# EasyEDA Pro project rckid3_devboard.eprj, board RCKid (continued)
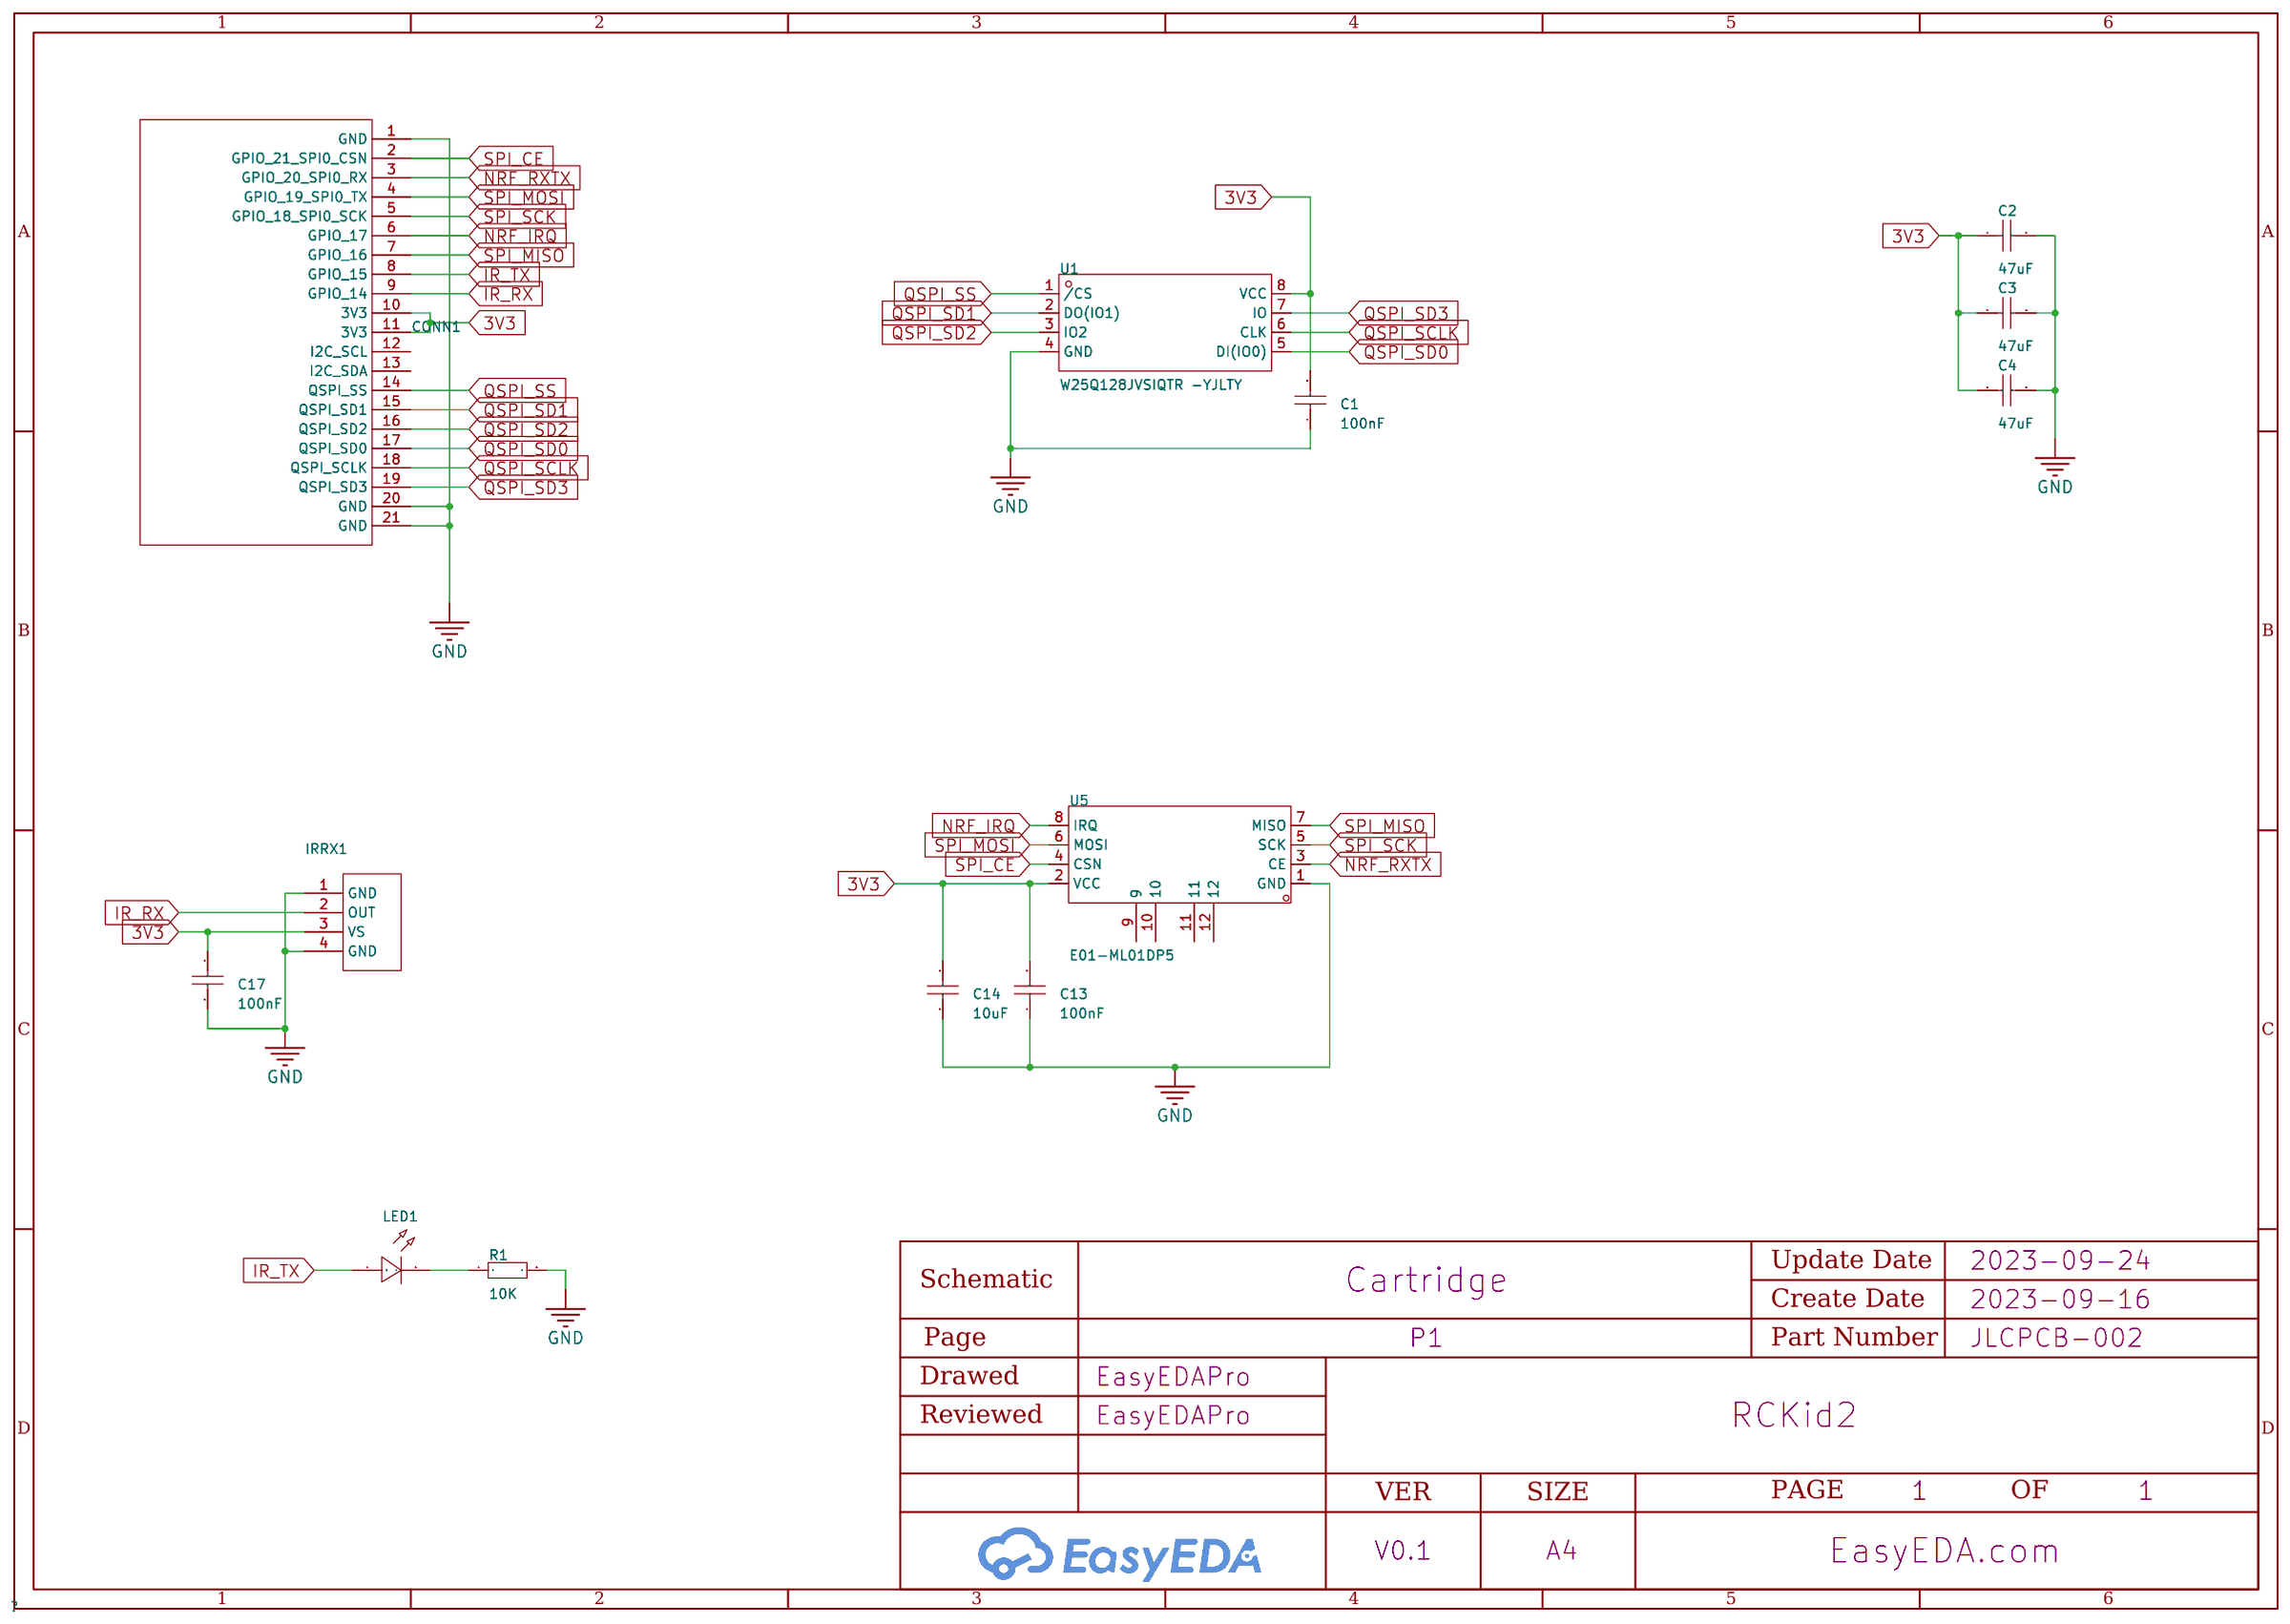
[diagram p0: NRF24L01P]
## Footprints (pads in the part's own frame, mm; a bottom-side part is the same pattern mirrored in y, then rotated) (continued)
SMT wire pad (2)
  rect 2.54x1.524 smd: 1(0,0)
  rrect 2.54x1.524 smd: 2(0,-2.54)
SOD-323_L1.8-W1.3-LS2.5-RD
  rect 1x0.75 smd: 1(-1.173,0) 2(1.173,0)
SOT-23-3_L2.9-W1.6-P1.90-LS2.8-BR
  rect 1.07x0.6 smd: 1(1.235,-0.95) 2(1.235,0.95) 3(-1.235,0)
SOT-23-6_L2.9-W1.6-P0.95-LS2.8-BR
  rect 1.1x0.6 smd: 1(1.35,-0.95) 2(1.35,0) 3(1.35,0.95) 4(-1.35,0.95) 5(-1.35,0) 6(-1.35,-0.95)
SOT-23_L2.9-W1.3-P1.90-LS2.4-BR
  rect 1x0.8 smd: 1(1.15,-0.95) 2(1.15,0.95) 3(-1.15,0)
TESTPOINT-SMD_BD1.5_P70-5000045R
  round 2 smd: 1(0,0)
TF-SMD_TF-01A
  rect 0.6x1.3 smd: 1(2.3,5.276) 2(1.2,5.276) 3(0.101,5.276) 4(-1,5.276) 5(-2.099,5.276) 6(-3.2,5.276) 7(-4.3,5.276) 8(-5.399,5.276) 9(-6.5,5.276)
  rect 1.2x1.4 smd: 10(-7.599,4.426) 13(7.08,4.426)
  rect 1.2x2 smd: 11(-7.76,-5.276) 12(7.76,-5.276)
UDFN-16_L3.3-W1.4-P0.40-BL-EP
  rect 0.2x0.4 smd: 1(-1.4,-0.6) 2(-1,-0.6) 3(-0.6,-0.6) 4(-0.2,-0.6) 5(0.2,-0.6) 6(0.6,-0.6) 7(1,-0.6) 8(1.4,-0.6) 9(1.4,0.6) 10(1,0.6) 11(0.6,0.6) 12(0.2,0.6) 13(-0.2,0.6) 14(-0.6,0.6) 15(-1,0.6) 16(-1.4,0.6)
  rect 2.8x0.4 smd: 17(0,0)
UQFN-10_L2.0-W1.5-P0.50-BL-EP
  rect 0.3x0.58 smd: 1(-0.748,-0.64) 4(0.752,-0.64) 6(0.752,0.64) 9(-0.748,0.64)
  rect 0.25x0.58 smd: 2(-0.248,-0.64) 3(0.252,-0.64) 7(0.252,0.64) 8(-0.248,0.64)
  rect 0.63x0.35 smd: 5(0.86,0) 10(-0.86,-0.002)
USB-C-SMD_TYPE-C-F02C-1BBWC1.6
  oval 1.2x2 hole 0.65x1.4: 13(5.62,1.425) 16(-5.62,1.425)
  oval 1.2x2.4 hole 0.65x1.8: 14(5.62,-2.575) 15(-5.62,-2.575)
  rect 0.3x1.1 smd: A5(-1.25,2.575) A6(-0.25,2.575) A7(0.25,2.575) A8(1.25,2.575) B5(1.75,2.575) B6(0.75,2.575) B7(-0.75,2.575) B8(-1.75,2.575)
  rect 0.6x1.1 smd: A9B4(2.4,2.575) A12B1(3.2,2.575) B9A4(-2.4,2.575) B12A1(-3.2,2.575)
VSON-6_L1.5-W1.5-P0.50-TL
  rect 0.6x0.25 smd: 1(-0.575,0.5) 2(-0.575,0) 3(-0.575,-0.5)
  rect 1x0.25 smd: 4(0.575,-0.5) 5(0.575,0) 6(0.575,0.5)
VSON-8_L3.0-W3.0-P0.65-TL-EP
  rect 0.85x0.34 smd: 1(-1.476,0.975) 2(-1.476,0.325) 3(-1.476,-0.325) 4(-1.476,-0.976) 5(1.476,-0.976) 6(1.476,-0.325) 7(1.476,0.325) 8(1.476,0.976)
  custom 1.52x3.42 smd: 9(0,-0.005)
WQFN-24_L4.0-W4.0-P0.50-TL-EP2.6
  rect 0.85x0.25 smd: 1(-2.025,1.25) 2(-2.025,0.75) 3(-2.025,0.25) 4(-2.025,-0.25) 5(-2.025,-0.75) 6(-2.025,-1.25) 13(2.025,-1.25) 14(2.025,-0.75) 15(2.025,-0.25) 16(2.025,0.25) 17(2.025,0.75) 18(2.025,1.25)
  rect 0.25x0.85 smd: 7(-1.25,-2.025) 8(-0.75,-2.025) 9(-0.25,-2.025) 10(0.25,-2.025) 11(0.75,-2.025) 12(1.25,-2.025) 19(1.25,2.025) 20(0.75,2.025) 21(0.25,2.025) 22(-0.25,2.025) 23(-0.75,2.025) 24(-1.25,2.025)
  rect 2.6x2.6 smd: 25(0.001,0)

## Nets
As in the schematic.

Pads without a net: 3V3 2; AMP 2; AUDIO 33; DISPLAY 1 2 3 4 8 25 26 27 28 34 35 36 37 38 39 40 41 42; HEADSET 5 6; L15 7 8 9 10; microSD 9 12 13; PWR 4 24; R88 2; RADIO 1 15 16 20 21; RP2350B 35 59; U26 4 10 11; U41 2 5; USB 13 14 15 16 A8 B8; VDD 2

## Via types
v1: diameter 0.5, hole 0.3, Top Layer to Bottom Layer, 660 vias

## Routing (per net, layer and track width the routed paths; a pad name or vN(x,y) marks a point on that pad's centre or on a via; arc(x,y) is an arc through that point)
3V3: length 31.2
  Top Layer w0.15: U26.5 44.9,38.69 43.9,39.69 U26.12 ; v1(47.7,41.79) 48.37,41.79 R124.2 ; 44.9,28.39 44.9,29.59 45.2,29.59 v1(45.8,30.19)
  Top Layer w0.25: U26.5 46.85,38.69 C95.2 ; U40.8 38.79,52.94 ; U41.1 45.85,53.84 45.2,53.19 44.74,53.19 C235.2 ; U26.8 45.05,40.94 45.55,41.44 45.55,41.99 ; AVR.4 49.25,44.8 C118.2
  Top Layer w0.3: U33.5 56.3,45.39 55.35,46.34 U33.1
  Top Layer w0.5: R45.2 v1(42.4,45.39) ; C234.2 38.8,52.94 v1(38.8,52.19) ; v1(52.8,46.19) 53.6,46.19 53.75,46.34 U33.1 ; C95.2 v1(46.9,37.79) ; C235.2 v1(44.5,52.09) ; 45.55,41.99 45.5,42.05 v1(45.5,42.69) ; v1(49.5,43.69) 49.5,44.44 C118.2 ; R46.2 v1(42.4,44.09)
  Bottom Layer w0.15: v1(45.8,30.19) 45.8,35.19 v1(45.4,35.59)
  vias: v1(45.4,36.39) v1(46.2,36.39) v1(46.2,35.59)
5V: length 20.1
  Top Layer w0.25: v1(62.05,45.14) 62,45.19 58.8,45.19 57.65,46.34 U33.6
  Top Layer w0.3: v1(40.4,25.29) 39.45,26.24 39.3,26.24 C143.2 39.11,26.24 LED11.2 ; v1(57,23.49) 57,22.64 C144.2 57.05,22.5 LED12.2 ; LED8.2 72.1,51.94 C102.2 71.86,51.99 v1(71.1,51.99) ; LED10.2 30.45,43.39 C104.2 v1(31.3,43.59)
  Top Layer w0.5: 52.3,22.59 v1(52.7,22.19) v1(51.9,22.19) 52.3,22.59 ; 52.3,22.59 C82.2 52.15,23.04 5V.1
  vias: v1(60.4,29.89)
5V_ON: length 30.8
  Top Layer w0.15: v1(44.9,46.29) 44.9,45.82 R48.1 ; 5V.3 50.5,24.89 v1(49.2,24.89) ; AVR.21 46.15,48.44 45.9,48.69 45.3,48.69 44.9,48.29 v1(44.9,48.09)
  Bottom Layer w0.15: v1(49.2,24.89) 44.2,29.89 44.2,45.19 44.9,45.89 v1(44.9,46.29) v1(44.9,48.09)
DVDD: length 10.3
  Top Layer w0.2: C114.2 22.6,78.09 v1(23,78.49) 23.3,78.79 RP2350B.51 ; RP2350B.32 29.6,86.09 v1(29.4,86.29) 28.8,86.89 28.8,87.05 ; C115.2 v1(37.5,78.69) 37.3,78.69 37.2,78.79 RP2350B.10
GND: length 81.5
  Top Layer w0.15: R113.2 17.93,19.42 v1(17.9,19.39) ; 30.5,19.29 v1(30.5,20.09) 30.5,20.79 ; U40.3 42.45,53.44 v1(42.6,53.59) ; v1(51.1,42.79) 50.53,42.79 50.5,42.82
  Top Layer w0.2: 19.6,6.26 19.8,6.06 v1(19.8,5.39) ; v1(21,5.39) R57.2 ; v1(28,88.19) 28.55,88.19 28.6,88.14
  Top Layer w0.25: v1(73.7,18.59) 74.02,18.91 74.02,19.5 ; v1(20,79.09) C110.1 ; v1(32,88.29) 31.26,88.29 31.2,88.24 ; v1(28.1,90.39) 28.1,89.95 C154.2 ; U39.2 29.35,92.89 v1(28.2,92.89) ; v1(40.4,78.69) C115.1 ; 75.35,34.74 74.35,35.74 AUDIO.7 ; 75.35,34.74 75.85,34.24 AUDIO.28 ; 75.35,34.74 AUDIO.12 ; AVR.25 48.75,47.94 AVR.3 ; U39.4 31.65,91.09 v1(33,91.09) ; v1(72.8,17.59) 73.02,17.37 RADIO.3 ; v1(22.1,72.69) 22.1,73.55 ; C107.1 39.74,73.95 39.74,73.9 39.85,73.79 v1(39.9,73.79) ; v1(72.3,39.29) 72.3,38.55 C209.1 ; v1(35.6,87.29) 35.6,86.55 C109.1 ; v1(58.1,23.49) 58.1,22.65 C144.1 ; LED12.3 58.1,19.59 v1(58.1,18.79) ; 81.3,24.59 80.9,24.99 80.5,24.99 ; LED8.3 74.9,52.89 v1(74.9,53.79) ; v1(33.3,89.49) C153.2 ; C167.1 29.45,69.79 v1(30.2,69.79) ; 81.4,24.59 v1(83,22.99) ; v1(40.4,81.19) C112.1 ; 46.3,52.49 v1(46.3,51.89) ; v1(20,78.09) C114.1 ; v1(23.1,85.19) C111.1 ; AUDIO.17 73.85,32.64 v1(74.5,33.29) ; v1(35.6,69.69) C108.1
  Top Layer w0.3: v1(70.7,74.59) R55.2 ; C143.1 v1(39.2,24.39) ; 72,52.94 v1(72,53.79) ; LED10.3 28.9,40.99 v1(28.9,40.09) ; LED11.3 36.5,25.29 v1(36.5,24.39) ; C104.1 v1(28.1,43.59)
  Top Layer w0.4: v1(81.4,35.39) 81.1,35.09 C192.1 ; v1(82.7,35.39) 82.1,34.79 C204.2 ; v1(31.9,10.59) USB.A12B1 32.67,9.56 v1(32.7,9.59) ; v1(25.5,10.59) USB.B12A1 25.48,9.59 v1(24.7,9.59) ; v1(74.9,28.09) 74.9,29.05 ; v1(81.1,36.59) 80.14,36.59 C203.2 ; v1(70.9,25.29) R104.1
  Top Layer w0.5: 44.5,54.09 44.5,54.39 v1(45,54.89) ; v1(18.5,21.29) 18.5,20.59 ; v1(24.6,27.79) 24.6,26.99 ; 24.6,26.99 v1(23.9,26.99) ; 24.6,26.99 24.6,26.79 ; 37.5,52.99 36.8,52.99 v1(36.79,53) ; v1(50.6,43.69) 50.6,44.45 C118.1 ; v1(68.7,74.79) 67.58,74.79 Q6.2 67.5,74.78 v1(67.5,75.59) ; 73.5,22.49 v1(73.5,21.79) 73.5,21.09 ; v1(42.4,50.59) 41.6,50.59 ; v1(50.6,34.79) 50.6,35.49 ; v1(50.9,37.39) 50.9,38.39 ; C132.1 66,89.09 v1(65,89.09) ; 55.8,51.09 56.4,51.09 v1(56.9,51.59) ; 37.7,53.99 37,53.99 v1(36.99,54) ; 26.5,26.99 26.4,26.99 ; 26.5,26.99 26.5,26.89 ; 26.5,26.99 v1(26.5,27.79) ; 26.5,26.99 v1(27.3,26.99) ; C81.1 v1(45.2,24.69) ; v1(56.89,52.7) 56.88,52.69 55.9,52.69 ; v1(51.1,36.39) 51.8,36.39 ; v1(46.9,40.79) 46.9,39.89 ; 21.2,20.39 21.1,20.39 v1(20.5,19.79) ; v1(46.6,42.69) 46.6,42.09 ; v1(21.4,17.89) 21.4,18.79 ; v1(46.3,44.39) 45.5,44.39 ; v1(53.3,45.39) 54.3,45.39 ; v1(63,8.49) 61.8,8.49 ; v1(24.1,16.99) 24.1,17.69
  vias: v1(-15.5,49.69) v1(-15.5,48.59) v1(-15.4,44.99) v1(-15.3,43.29) v1(-15.1,46.79) v1(-14.55,54.38) v1(-14.4,62.49) v1(-13.8,42.39) v1(-13.6,45.59) v1(-13.5,77.89) v1(-13.5,75.89) v1(-13.5,73.89) v1(-13.2,48.29) v1(-13.1,50.19) v1(-13,43.79) v1(-12.9,60.99) v1(-12.7,45.99) v1(-12.6,39.99) v1(-12,74.59) v1(-12,61.89) v1(-11.7,48.49) v1(-11.2,44.69) v1(-11,62.59) v1(-10.8,49.89) v1(-10.5,46.59) v1(-10.3,58.79) v1(-10.3,43.49) v1(-10.2,48.29) v1(-10,73.49) v1(-10,31.99) v1(-9.2,44.49) v1(-8.6,42.79) v1(-8.4,58.99) v1(-8.4,56.19) v1(-8.4,47.99) v1(-8.4,36.19) v1(-8.4,33.79) v1(-8.2,74.59) v1(-8.2,54.09) v1(-8,45.79) v1(-7.8,49.69) v1(-7.7,32.59) v1(-7.6,40.19) v1(-7.2,47.59) v1(-6.2,42.89) v1(-6.2,39.29) v1(-6.1,37.49) v1(-5.9,77.49) v1(-5.9,71.99) v1(-5.9,69.99) v1(-5.9,67.99) v1(-5.9,65.99) v1(-5.9,64.19) v1(-5.8,47.29) v1(-5.7,74.59) v1(-5.6,44.99) v1(-5.6,41.59) v1(-5.1,34.69) v1(-4.5,44.29) v1(-4.3,83.89) v1(-4.3,47.89) v1(-3.9,65.99) v1(-3.9,64.19) v1(-3.9,36.99) v1(-3.7,45.69) v1(-3.5,71.99) v1(-3.1,74.59) v1(-3,77.59) v1(-2.2,38.89) v1(-1.9,78.39) v1(-1.8,76.59) v1(-1.7,51.59) v1(-1.5,41.79) v1(-1.2,38.89) v1(-1.1,46.19) v1(-1,47.89) v1(-0.9,64.19) v1(-0.7,77.29) v1(-0.6,74.59) v1(-0.2,58.19) v1(0,61.09) v1(0,46.19) v1(0.2,43.59) v1(0.4,52.09) v1(0.7,77.29) v1(0.7,53.69) v1(0.7,49.59) v1(1.2,47.79) v1(1.7,74.59) v1(1.7,40.69) v1(1.9,51.39) v1(1.9,46.49) v1(2,61.09) v1(2.1,44.09) v1(2.2,77.59) v1(2.6,57.49) v1(2.7,73.59) v1(2.7,52.49) v1(2.9,40.09) v1(3.2,55.69) v1(3.2,43.19) v1(3.3,76.99) v1(3.3,45.59) v1(3.7,64.19) v1(3.7,49.99) v1(3.9,74.99) v1(4.1,59.99) v1(4.2,57.09) v1(4.2,41.89) v1(4.4,76.19) v1(4.4,43.89) v1(4.5,47.09) v1(4.6,53.49) v1(4.6,49.19) v1(4.9,40.59) v1(5.2,42.69) v1(5.4,81.79) v1(5.5,40.19) v1(5.6,43.79) v1(5.7,52.59) v1(6,50.59) v1(6.1,94.89) v1(6.2,47.59) v1(6.4,88.19) v1(6.4,83.79) v1(6.6,45.29) v1(6.7,46.49) v1(6.9,38.69) v1(7.1,41.59) v1(7.2,48.99) v1(7.3,88.09) v1(7.4,44.39) v1(7.5,51.49) v1(7.9,96.79) v1(7.9,47.29) v1(8.5,86.39) v1(9,90.79) v1(9,40.49) v1(9.6,51.19) v1(9.8,45.79) v1(10.7,46.29) v1(11.2,93.39) v1(16.9,107.89) v1(17,103.19) v1(18.2,103.99) v1(19,103.69) v1(20.2,109.89) v1(20.2,103.99) v1(21.3,103.89) v1(22.2,103.99) v1(22.9,69.79) v1(23.5,107.09) v1(24.2,103.99) v1(25.8,22.39) v1(25.8,20.79) v1(25.8,13.59) v1(26.2,103.99) v1(26.4,109.99) v1(27.5,20.79) v1(27.6,22.39) v1(28.2,103.99) v1(28.8,80.39) v1(28.8,78.99) v1(28.8,77.59) v1(29.4,109.99) v1(30.1,53.49) v1(30.2,103.99) v1(30.2,80.39) v1(30.2,78.99) v1(30.2,77.59) v1(30.5,15.39) v1(31.5,24.89) v1(31.6,80.39) v1(31.6,78.99) v1(31.6,77.59) v1(32.2,103.99) v1(32.2,49.99) v1(34.1,109.99) v1(34.2,103.99) v1(36.2,103.99) v1(36.4,107.89) v1(36.4,105.49) v1(38.1,109.99) v1(42.2,109.99) v1(42.2,103.59) v1(43.2,6.49) v1(43.7,2.49) v1(44.6,-2.01) v1(44.8,-0.01) v1(45.2,31.89) v1(45.8,6.99) v1(46.1,-4.31) v1(46.3,31.89) v1(47,4.79) v1(47.2,1.09) v1(47.3,8.29) v1(47.5,109.99) v1(47.9,8.19) v1(48.2,48.99) v1(48.2,47.39) v1(48.8,8.49) v1(49.5,1.49) v1(49.6,23.99) v1(49.7,9.19) v1(49.8,48.99) v1(49.8,47.39) v1(50.4,103.39) v1(50.5,8.89) v1(50.5,1.79) v1(50.6,6.29) v1(50.8,10.19) v1(50.9,109.99) v1(51.2,-0.61) v1(51.7,10.69) v1(51.8,6.69) v1(51.9,10.79) v1(51.9,8.09) v1(52,7.89) v1(52.1,9.49) v1(52.1,4.69) v1(52.2,25.69) v1(52.8,9.49) v1(53.1,10.89) v1(53.4,5.89) v1(53.5,9.29) v1(54.4,109.99) v1(54.4,11.49) v1(54.9,103.59) v1(55,7.99) v1(55.1,92.19) v1(55.7,10.29) v1(55.9,12.79) v1(56,11.79) v1(56.7,39.99) v1(56.7,39.19) v1(56.9,13.49) v1(57,103.19) v1(57,9.89) v1(57.2,11.59) v1(57.4,109.99) v1(57.6,8.79) v1(57.9,12.79) v1(58.1,13.79) v1(58.1,6.59) v1(58.4,103.59) v1(58.5,10.69) v1(58.5,9.89) v1(58.6,11.79) v1(59,42.59) v1(59.5,6.29) v1(59.7,103.49) v1(60.4,109.99) v1(60.4,30.89) v1(61.2,103.09) v1(61.7,103.69) v1(62.6,103.19) v1(63.3,109.99) v1(63.5,103.19) v1(64.7,103.39) v1(64.8,30.79) v1(65.2,109.99) v1(66.2,103.99) v1(66.2,99.99) v1(66.2,95.99) v1(67.2,109.99) v1(67.4,106.49) v1(70.2,103.99) v1(70.2,95.99) v1(70.2,91.99) v1(70.2,87.99) v1(71,23.09) v1(71.3,107.29) v1(71.8,103.69) v1(72,25.69) v1(72.8,18.59) v1(73.2,109.99) v1(73.7,17.59) v1(74.2,103.99) v1(74.2,99.99) v1(74.2,95.99) v1(74.2,91.99) v1(74.2,87.99) v1(74.5,35.69) v1(74.9,25.69) v1(75.4,15.89) v1(75.8,25.39) v1(76.5,103.89) v1(76.8,105.19) v1(76.8,35.79) v1(76.85,33.24) v1(77.5,109.99) v1(78.2,103.99) v1(78.2,95.99) v1(78.2,91.99) v1(78.2,87.99) v1(79.2,5.09) v1(79.6,106.19) v1(79.6,103.99) v1(80.6,109.79) v1(81.1,65.09) v1(82.2,103.99) v1(82.2,99.99) v1(82.2,97.99) v1(82.2,95.99) v1(82.2,93.99) v1(82.2,91.99) v1(82.2,89.99) v1(82.2,87.99) v1(82.2,85.99) v1(82.2,83.99) v1(82.2,81.99) v1(82.2,79.99) v1(82.2,77.99) v1(82.2,75.69) v1(82.2,72.99) v1(82.2,70.09) v1(82.7,65.09) v1(82.7,31.29) v1(83.5,107.89) v1(83.5,105.29) v1(83.6,67.79) v1(83.6,26.39) v1(85.8,42.49) v1(92.3,73.69) v1(93.1,75.09) v1(94.7,73.69) v1(95.2,92.59) v1(95.2,88.89) v1(95.2,84.79) v1(96.2,82.29) v1(96.7,83.99) v1(97.2,90.49) v1(97.3,73.69) v1(97.5,85.39) v1(97.6,72.29) v1(98.2,86.79) v1(98.5,78.29) v1(98.6,93.19) v1(98.62,72.24) v1(98.7,82.49) v1(98.7,75.79) v1(98.9,72.89) v1(99,89.39) v1(99.2,80.39) v1(99.6,76.29) v1(99.6,71.39) v1(99.8,84.59) v1(99.9,73.69) v1(100,90.49) v1(100.9,88.09) v1(101.5,86.19) v1(101.5,80.49) v1(101.7,91.39) v1(101.7,75.09) v1(101.9,79.89) v1(101.9,77.19) v1(102.1,93.69) v1(102.4,82.89) v1(102.4,74.29) v1(102.6,89.69) v1(102.8,84.49) v1(103.5,78.19) v1(103.6,79.79) v1(103.7,73.69) v1(103.8,87.19) v1(104.1,75.39) v1(104.2,85.29) v1(104.7,93.79) v1(104.8,80.99) v1(104.8,72.09) v1(104.9,89.99) v1(105.3,83.59) v1(105.4,77.19) v1(106.2,80.29) v1(106.3,73.69) v1(106.6,85.69) v1(106.8,88.29) v1(107.3,91.69) v1(107.3,77.89) v1(107.5,74.59) v1(107.6,82.79) v1(109.2,72.89) v1(111,73.69)
VBATT: length 4
  Bottom Layer w0.15: v1(33,16.49) R126.2
  Bottom Layer w0.5: v1(33,16.49) v1(33,14.49)
VCC: length 10.7
  Top Layer w0.15: 42.7,32.49 42.7,31.39
  Top Layer w0.5: v1(48.8,23.99) 5V.5 46.8,23.99 C81.2
  Top Layer w0.7: C220.2 C219.2 22.45,25.39 L17.2 22.1,27.96 AAA_PWR.2
  vias: v1(27.5,25.59) v1(27.5,24.79) v1(28.3,25.59) v1(28.3,24.79) v1(29.1,25.59) v1(29.1,24.79) v1(39.4,32.99) v1(39.4,32.29) v1(40.1,32.99) v1(40.1,32.29) v1(49.4,39.89) v1(49.4,39.19) v1(50.1,39.89) v1(50.1,39.19)
VDD_EN: length 28.1
  Top Layer w0.15: v1(42,54.99) 41.7,54.99 41.2,54.49 U40.5 ; 52.7,38.19 52.2,38.19 52,38.39 v1(52,38.59) ; v1(46.6,50.49) 43.6,50.49 v1(42.4,51.69) 41.84,52.25 U40.1 ; AVR.5 49.75,45.44 49.9,45.29 v1(50.8,45.29)
  Bottom Layer w0.15: v1(46.6,50.49) 47.5,50.49 50.8,47.19 v1(50.8,45.29) 50.8,44.29 52,43.09 v1(52,38.59) ; v1(42,54.99) 42,52.09 v1(42.4,51.69)
ACCEL_INT: length 9.4
  Top Layer w0.15: v1(44.8,41.69) 44.55,41.44 U26.9 ; v1(45.6,48.09) 45.9,48.09 46.05,47.94 AVR.22
  Bottom Layer w0.15: v1(44.8,41.69) 44.8,44.79 45.6,45.59 v1(45.6,48.09)
AUDIO_INT: length 67.5
  Top Layer w0.15: AUDIO.11 69.95,35.24 68.9,36.29 68.9,39.99 66.9,41.99 66.9,53.49 63.7,56.69 50.7,56.69 50.3,57.09 47.5,57.09 46,58.59 46,62.39 39.1,69.29 39.1,71.69 36,74.79 36,75.09 35.5,75.59 RP2350B.2
AUDIO_MICBIAS: length 7
  Top Layer w0.15: AUDIO.19 74.85,31.44 v1(75.1,31.19) ; R123.2 v1(70.9,30.89) R103.2
  Bottom Layer w0.15: v1(70.9,30.89) 74.8,30.89 v1(75.1,31.19)
AUDIO_RESET: length 74.8
  Top Layer w0.15: RP2350B.8 36.8,77.99 37.4,77.39 39.5,77.39 42.1,74.79 42.1,70.74 49.15,63.69 49.8,63.69 51.61,61.89 51.61,60.29 52.2,59.69 65.3,59.69 69.9,55.09 69.9,43.49 70.5,42.89 76.5,42.89 78.8,40.59 78.8,35.99 78.55,35.74 AUDIO.31
AVR_INT: length 33.7
  Top Layer w0.15: RP2350B.80 34.91,74.08 v1(37.8,71.19) ; v1(42.4,49.19) 44.1,49.19 44.2,49.29 46,49.29 46.35,48.94 AVR.20
  Bottom Layer w0.15: v1(42.4,49.19) 39.6,51.99 39.6,56.24 38.7,57.14 38.7,70.29 v1(37.8,71.19)
AVR_TX: length 36.5
  Top Layer w0.15: v1(28.8,57.09) 30.3,57.09 40.45,46.94 AVR.24
  Bottom Layer w0.15: DEBUG.1 24.02,57.09 v1(28.8,57.09)
BTN_1: length 45
  Top Layer w0.15: D17.2 D9.2 59.23,51.19 57.8,51.19 v1(56.5,49.89) 56.05,49.44 51.02,49.44
  Top Layer w0.2: D5.2 51,18.69 v1(51.9,19.59)
  Bottom Layer w0.15: v1(51.9,19.59) 53.9,21.59 53.9,47.29 56.6,49.99
BTN_2: length 46.4
  Top Layer w0.15: 51.02,47.94 59.28,47.94 D14.2 D10.2
  Top Layer w0.2: D6.2 49.3,18.79 49.5,18.99 v1(50.2,18.99)
  Bottom Layer w0.15: v1(58.3,47.99) 57.6,47.99 55.1,45.49 55.1,20.49 53.6,18.99 v1(50.2,18.99)
BTN_3: length 48.2
  Top Layer w0.15: D11.2 52.7,17.89 51.8,16.99 48.5,16.99 47.6,17.89 D7.2 ; D15.2 58.3,49.59 v1(57.9,49.19) 57.15,48.44 51.02,48.44
  Top Layer w0.2: v1(54,20.49) 54,19.52 52.7,18.22
  Bottom Layer w0.15: v1(54,20.49) 54.5,20.99 54.5,45.79 v1(57.9,49.19)
BTN_4: length 38.8
  Top Layer w0.15: v1(52.9,44.09) 50.83,46.17 AVR.6
  Top Layer w0.2: D12.2 44.2,18.89 44.5,19.19 v1(45,19.19) 45.6,19.19 45.9,18.89 D8.2
  Bottom Layer w0.15: v1(45,19.19) 45.7,19.89 51.3,19.89 53.3,21.89 53.3,43.69 v1(52.9,44.09)
BTN_ABXY: length 102.7
  Top Layer w0.15: 51.02,47.44 57.95,47.44 v1(58.3,47.09) ; B1.4 B1.2 v1(71.2,45.59) ; 60.1,18.09 B2.2 55.7,17.99 v1(55,18.69) 52.7,16.39 41.75,16.39 40.2,17.94 B3.4 ; A1.4 A1.2 v1(56.5,33.49)
  Top Layer w0.2: B3.4 B3.2 ; B2.4 B2.2
  Bottom Layer w0.15: v1(55,18.69) 55.7,19.39 55.7,32.69 v1(56.5,33.49) 55.7,34.29 55.7,45.19 57.6,47.09 v1(58.3,47.09) 69.7,47.09 v1(71.2,45.59)
BTN_CTRL: length 62.1
  Top Layer w0.15: v1(60.5,50.39) 58.2,50.39 56.75,48.94 51.02,48.94 ; v1(79.7,38.89) v1(79.7,42.99) 79.7,54.89 v1(82,57.19)
  Bottom Layer w0.15: VOL_UP.2 v1(79.7,42.99) 74.3,48.39 71.9,48.39 69.9,50.39 v1(60.5,50.39) ; v1(79.7,38.89) 82,36.59 VOL_DOWN.2